# EasyEDA Pro project Geacon3.eprj, board Geacon_pmw3610
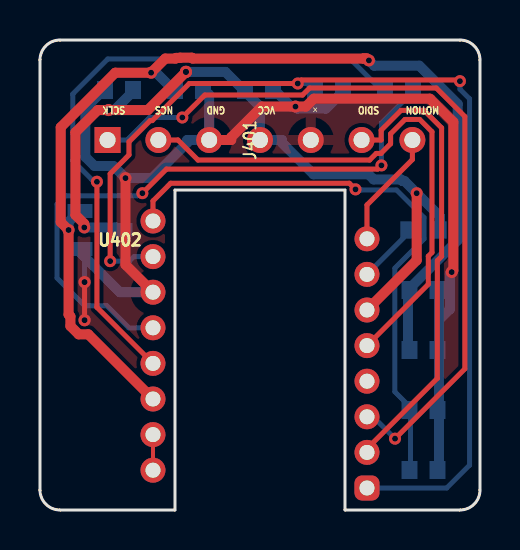
[diagram p3: board, top side]
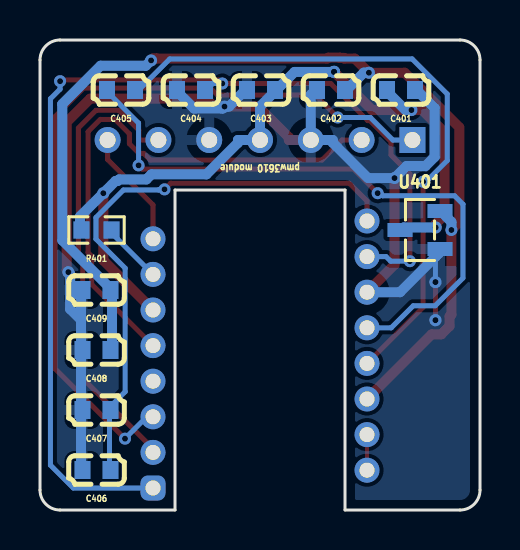
[diagram p4: board, bottom side, seen from below]

Outline 22 x 23.5 mm; copper layers: Top Layer, Bottom Layer. Coordinates in mm from the lower left corner of the outline.
Outline path: 0,22.5 arc(0.29,23.21) 1,23.5 21,23.5 arc(21.71,23.21) 22,22.5 22,1 arc(21.71,0.29) 21,0 15.25,0 15.25,16 6.75,16 6.75,0 1,0 arc(0.29,0.29) 0,1 0,22.5
Stack: Top Layer 0.035mm / Dielectric1 1.51mm FR4 er 4.5 / Bottom Layer 0.035mm

## Design rules (mm)
spacing safeClearance (default): track to track 0.152, other pairs 0.152 to 0.3
track width trackWidth (default): min 0.127, default 0.254, max 2.54
differential pair differentialPair (default): width min 0.127, default 0.254, max 2.54; gap min 0.152, default 0.152
via viaSize (default): diameter min 0.5, default 0.61, max 10; hole min 0.3, default 0.305, max 6
net GND uses CopperRegion1

## Placement (name value [footprint] x y rotation side)
C401  1uF  [C0603]  3.95 21 0 bottom
C402  1uF  [C0603]  7.45 21 0 bottom
C403  100nF  [C0603]  10.95 21 0 bottom
C404  10nF  [C0603]  14.45 21 0 bottom
C405  100nF  [C0603]  17.95 21 0 bottom
C406  100nF  [C0603]  19.17 2 0 bottom
C407  10nF  [C0603]  19.17 5 0 bottom
C408  100nF  [C0603]  19.17 8 0 bottom
C409  3.3uF  [C0603]  19.17 11 0 bottom
J401  Conn_01x08  [roBa:pmw3610_connector_b]  11 18.5 90 top
R401  2MΩ  [R0603]  19.17 14 0 bottom
U401  MCP1700T-1802E/TT  [SOT-23-3_L2.9-W1.3-P1.90-LS2.4-BR]  3 14 180 bottom
U402  PMW3610  [roBa:PMW3610DM-SUDU 16Pin]  11 7.27 270 top

## Footprints (pads in the part's own frame, mm; a bottom-side part is the same pattern mirrored in y, then rotated)
C0603
  rect 0.8x0.9 smd: 1(-0.7,0) 2(0.7,0)
R0603
  rect 0.806x0.864 smd: 1(-0.753,0) 2(0.753,0)
roBa:pmw3610_connector_b
  rect 1.3x1.3 hole 0.8: 1(0,7.62)
  round 1.3 hole 0.8: 2(0,5.08) 3(0,2.54) 4(0,0) 5(0,-2.54) 6(0,-5.08) 7(0,-7.62)
roBa:PMW3610DM-SUDU 16Pin
  rrect 1.25x1.25 hole 0.75: 1(6.168,5.35)
  round 1.25 hole 0.75: 2(4.388,5.35) 3(2.608,5.35) 4(0.828,5.35) 5(-0.952,5.35) 6(-2.732,5.35) 7(-4.512,5.35) 8(-6.292,5.35) 9(-7.182,-5.35) 10(-5.402,-5.35) 11(-3.622,-5.35) 12(-1.842,-5.35) 13(-0.062,-5.35) 14(1.718,-5.35) 15(3.498,-5.35) 16(5.278,-5.35)
SOT-23-3_L2.9-W1.3-P1.90-LS2.4-BR
  rect 1.25x0.7 smd: 1(1,-0.95) 2(1,0.95) 3(-1,0)

## Nets
3.3V: C401.2 C403.1 J401.4 R401.2 U401.3 U402.6
+1V9: C402.1 C408.1 C409.1 U401.2 U402.14
GND: C401.1 C402.2 C403.2 C404.2 C406.2 C407.2 C408.2 C409.2 J401.3 J401.5 U401.1 U402.11
CS2: J401.2 U402.5
MOSI: J401.6 U402.2
MOT: J401.7 U402.8
NET-(U402-+VCSEL): C404.1 U402.1 U402.10
NET-(U402--VCSEL): U402.15 U402.16
NET-(U402-CN): C405.1 U402.13
NET-(U402-CP): C405.2 U402.12
NET-(U402-NRESET): R401.1 U402.7
NET-(U402-VCP): C406.1 C407.1 U402.9
SCK: J401.1 U402.3
UNCONNECTED-(U402-NC-PAD4): U402.4

## Via types
v1: diameter 0.61, hole 0.305, Top Layer to Bottom Layer, 3 vias
v2: diameter 0.6, hole 0.3, Top Layer to Bottom Layer, 19 vias

## Routing (per net, layer and track width the routed paths; a pad name or vN(x,y) marks a point on that pad's centre or on a via; arc(x,y) is an arc through that point)
3.3V: length 39.5
  Top Layer w0.5: v2(7.3,21.9) 5.39,20 v2(3.43,20) 2.89,20 1.77,18.88 1.77,14.75 2.21,14.31 v2(2.21,14.13) ; U402.6 18.83,12.48 v2(18.83,15.84)
  Bottom Layer w0.5: v2(2.21,14.13) 3.81,14.13 3.94,14 ; v2(7.3,21.9) 9.27,21.9 11,20.17 J401.4 12.1,18.5 12.1,18.36 13.68,16.78 16.43,16.78 16.68,16.53 18.05,16.53 18.12,16.45 18.22,16.45 v2(18.83,15.84) 20,14.67 20,14 ; v2(3.43,20) 3.72,20 4.72,21
  vias: v1(7.3,21.91)
+1V9: length 54.1
  Top Layer w0.5: v2(16.45,22.48) 16.34,22.58 16.18,22.58 16.17,22.57 7.63,22.57 7.59,22.61 7,22.61 6.99,22.61 6.81,22.61 6.78,22.57 6.26,22.57 v2(5.56,21.86) 3.76,21.86 1.04,19.14 1.04,14.39 v2(1.43,14) 1.43,9.77 1.52,9.68 1.52,9.2 1.94,8.78 2.42,8.78 U402.14
  Bottom Layer w0.5: v2(1.43,14) 1.43,14.41 1.97,14.95 2.06,14.95 ; v2(16.45,22.48) 16.71,22.21 18.97,22.21 20.89,20.3 20.89,13.49 18.4,11 18.4,8 ; 6.67,21 5.81,21.86 v2(5.56,21.86)
GND: length 65
  Top Layer w0.249: v1(2.23,9.49) v1(2.23,11.4)
  Top Layer w0.5: v2(4.27,16.6) 4.27,12.27 U402.11 ; J401.3 9.56,18.5 9.56,18.64 11.09,20.17 v2(12.77,20.17) 13.3,20.17 13.69,20.57 19.5,20.57 20.67,19.39 20.67,11.98 v2(20.58,11.89)
  Bottom Layer w0.249: v1(2.23,11.4) 2.23,12.66
  Bottom Layer w0.5: 2.06,13.05 2.06,12.82 2.23,12.66 4,10.89 U402.11 ; 3.17,21 2.27,20.09 2.27,17.66 2.72,17.2 3.67,17.2 v2(4.27,16.6) 5.59,16.6 7.36,18.36 7.36,18.5 J401.3 8.46,20.77 8.22,21 ; 19.95,9.5 20.49,10.04 20.49,11.81 v2(20.58,11.89) ; 19.95,9.5 19.95,11 ; 19.95,9.5 19.95,2 ; 11.72,21 12.55,20.17 v2(12.77,20.17) 12.88,20.07 14.29,20.07 15.22,21
CS2: length 27.5
  Top Layer w0.25: U402.5 19.42,11.29 19.42,12.69 19.6,12.87 19.6,18.91 18.98,19.53 18.25,19.53 17.53,18.81 17.53,18.31 17.05,17.83 16.81,17.83 16.48,17.5 7.9,17.5 6.9,18.5 J401.2
MOSI: length 23
  Top Layer w0.25: U402.2 16.35,3.07 19.87,6.58 19.87,12.47 20.08,12.68 20.08,19.11 19.2,19.98 18.05,19.98 17.06,18.99 17.06,18.5 J401.6
MOT: length 5.9
  Top Layer w0.25: U402.8 16.35,15.25 18.62,17.52 J401.7
NET-(U402-+VCSEL): length 52.4
  Top Layer w0.25: v2(21,21.44) 20.94,21.5 13.06,21.5 v2(12.89,21.33) 7.47,21.33 5.61,19.47 5.51,19.47 4.45,18.41 4.45,17.75 3.51,16.81 v2(3.51,12.44)
  Bottom Layer w0.25: v2(3.51,12.44) 4.47,12.44 4.7,12.67 U402.10 ; v2(21,21.44) 21,21.04 21.48,20.56 21.48,2.24 20.34,1.1 U402.1 ; 13.67,21 13.35,21.33 v2(12.89,21.33)
NET-(U402--VCSEL): length 1.8
  Top Layer w0.2: U402.16 U402.15
NET-(U402-CN): length 32.1
  Top Layer w0.25: U402.13 2.85,10.13 v2(2.85,16.41)
  Bottom Layer w0.25: 17.17,21 17.06,21 15.51,22.55 3.39,22.55 1.64,20.8 1.64,17.47 2.69,16.41 v2(2.85,16.41)
NET-(U402-CP): length 31
  Top Layer w0.25: v2(5.12,15.84) 6.32,17.05 16.89,17.05 v2(17.07,17.23)
  Bottom Layer w0.25: v2(5.12,15.84) 4.99,15.84 4.86,15.71 1.27,15.71 0.85,15.29 0.85,11.6 2.24,10.21 3.34,10.21 4.44,9.11 U402.12 ; 18.72,21 17.07,19.35 v2(17.07,17.23)
NET-(U402-NRESET): length 3
  Bottom Layer w0.25: U402.7 18.35,13.78 18.35,14
NET-(U402-VCP): length 29.2
  Top Layer w0.25: v2(15.78,16.03) 15.47,16.34 6.53,16.34 5.65,15.45 U402.9
  Bottom Layer w0.25: v2(15.78,16.03) 16.03,16.03 16.06,16 17.83,16 19.2,14.62 19.2,13.55 17.74,12.09 17.74,5.91 18.53,5.13 18.53,2.13 18.4,2
SCK: length 38.9
  Top Layer w0.25: v2(7.12,19.63) 8.24,20.75 13.13,20.75 13.48,21.1 19.82,21.1 21.24,19.67 21.24,7.06 v2(17.75,3.57)
  Bottom Layer w0.25: U402.3 16.66,4.66 v2(17.75,3.57) ; J401.1 4.36,18.5 5.48,19.63 v2(7.12,19.63)

## Copper pours and planes (outline as drawn; the poured copper is in the pictures)
GND on Top Layer: 29.79,28.03 -6.79,25.75 -6.41,-5.11 31.31,-4.35
GND on Bottom Layer: 29.15,27.84 -7.42,25.56 -7.04,-5.31 30.68,-4.54

## Text on the board
Bottom Silkscreen Layer: pmw3610 module
Top Silkscreen Layer: SCLK | NCS | GND | VCC | SDIO | MOTION | ×
